# EAGLE board MSP-EXP430FR4133 (EAGLE 6.5.0)
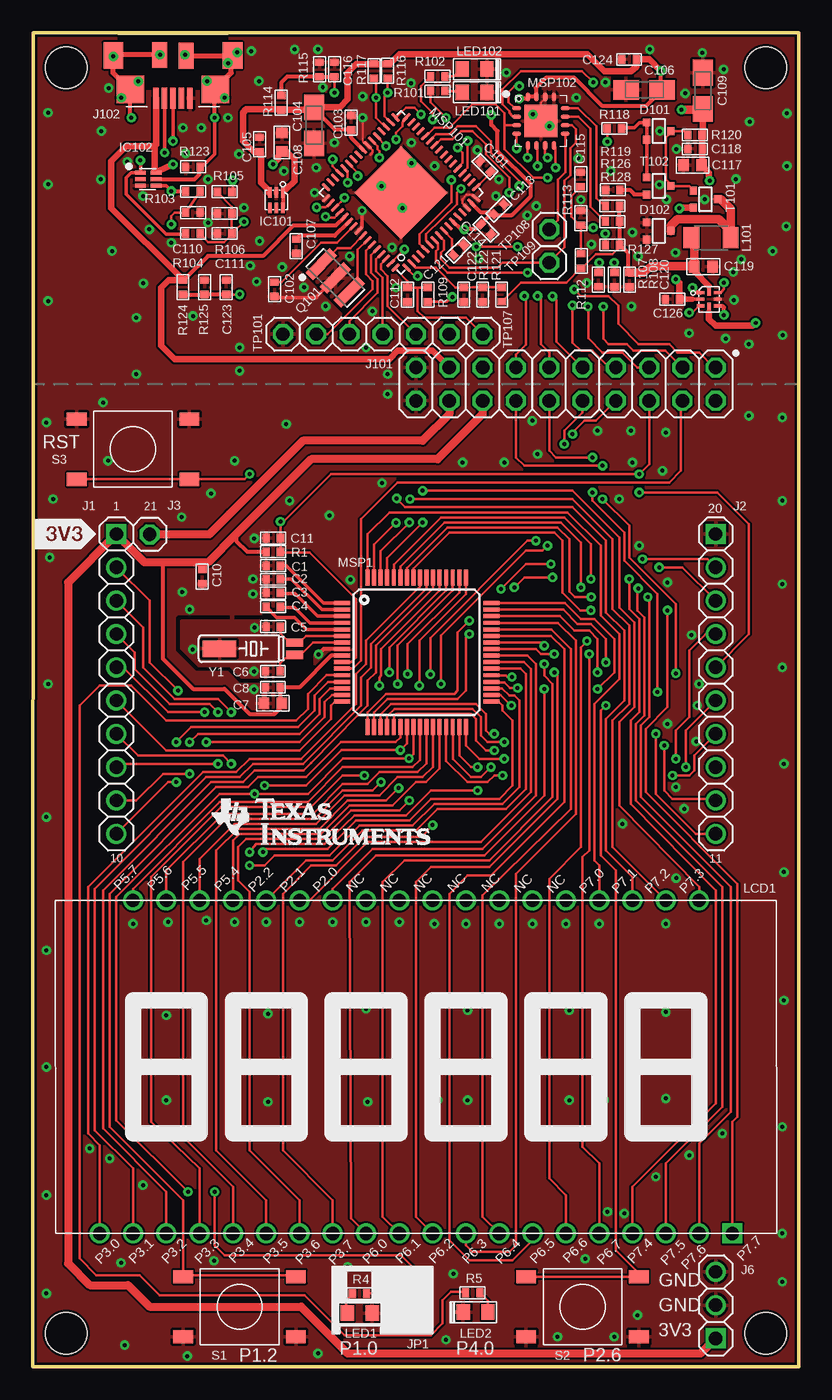
[diagram p6: board, top side]
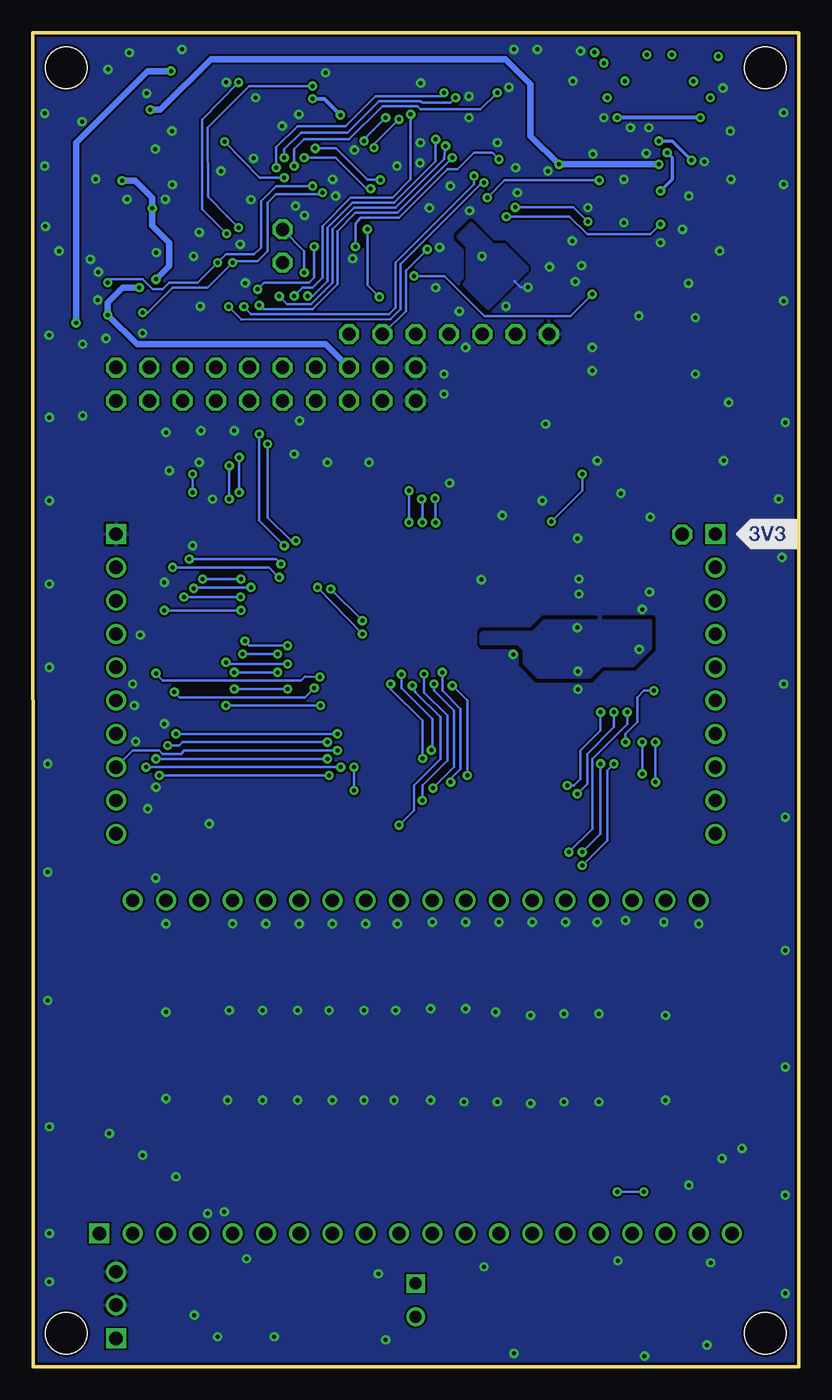
[diagram p7: board, bottom side, seen from below]

Size 58.45 x 101.73 mm. Coordinates in mm from the lower left corner, seen from the top.
Outline: 0,0 58.42,0 58.45,101.73 0.03,101.73 0,0
Copper layers (1*16): Top 0.0178mm / dielectric 12mil / Bottom 0.0178mm
Design rules "default": minimum track width 6mil, minimum drill 12mil, track to track 6mil, track to pad 6mil, pad to pad 6mil, via to via 8mil, smd to smd 0mil, copper to edge 8mil, drill to drill 8mil, minimum pad ring 10mil, minimum via ring 8mil, stop-mask expansion 3mil, vias tented up to drill 15mil, thermal gap 8mil
tRestrict: area 20.5,80.4 to 26.3,87.5; area 10.9,52.2 to 24.5,57.3
bRestrict: area 20.5,80.4 to 26.3,87.5; area 10.9,52.2 to 24.5,57.3

## Footprints (pad centres in the part's own frame; a part is rotated, then mirrored left to right if it is on the bottom)
C0402 = smd 0.55 x 0.65: 1 -0.55,0; 2 0.55,0
C0603 = smd 0.8 x 0.9: 1 -0.7,-0.05; 2 0.7,-0.05
A/3216-18R = smd 1.95 x 1.5: + 1.375,0; - -1.375,0
SOT323 = smd 0.6 x 0.55: 1 -0.65,-0.825; 2 0.65,-0.825; 3 0,1.025
WSON_DSE = smd 0.25 x 0.8: 1 0,0; 2 0.5,0; 3 1,0; 5 0.5,1.15; 6 0,1.15; P4 1,1.15
SON(DRY)6 = smd 0.81 x 0.305: 1 -0.1,0; 2 -0.1,-0.5; 3 -0.1,-1; 4 1.1,-1; 5 1.1,-0.5; 6 1.1,0
UQFN_RSE = smd 0.25 x 0.58: 1 -0.5,-0.65; 2 0,-0.65; 3 0.5,-0.65; 5 0.5,0.65; 6 0,0.65; 7 -0.5,0.65 | smd 0.58 x 0.25: 4 0.55,0; 8 -0.55,0
PINHEAFER1X10 = drill 1.016 square: 1 -11.43,0 | drill 1.016: 2 -8.89,0; 3 -6.35,0; 4 -3.81,0; 5 -1.27,0; 6 1.27,0; 7 3.81,0; 8 6.35,0; 9 8.89,0; 10 11.43,0
1X01 = drill 1.016 octagon: 1 0,0
PINHEADER1X3 = drill 1.016 square: 1 -2.54,0 | drill 1.016: 2 0,0; 3 2.54,0
2X10 = drill 1.016 octagon: 1 -11.43,-1.27; 2 -11.43,1.27; 3 -8.89,-1.27; 4 -8.89,1.27; 5 -6.35,-1.27; 6 -6.35,1.27; 7 -3.81,-1.27; 8 -3.81,1.27; 9 -1.27,-1.27; 10 -1.27,1.27; 11 1.27,-1.27; 12 1.27,1.27; 13 3.81,-1.27; 14 3.81,1.27; 15 6.35,-1.27; 16 6.35,1.27; 17 8.89,-1.27; 18 8.89,1.27; 19 11.43,-1.27; 20 11.43,1.27
EZFET_UX62M-B-5P = smd 0.42 x 1.6: 1 1.3,1.3; 2 0.65,1.3; 3 0,1.3; 4 -0.65,1.3; 5 -1.3,1.3 | smd 2.1 x 2.1: S1 -3.25,0.65; S2 3.25,0.65 | smd 1.5 x 2: S3 -4.55,-1.95; S4 4.55,-1.95 | smd 1.144 x 1.949: S5 -1.016,-1.93; S6 1.016,-1.981
JUMPER-2.54 = drill 0.914 square: 1 0,-1.27 | drill 0.914: 2 0,1.27
L3216C = smd 1.2 x 1.6: 1 -1.5,0; 2 1.5,0
FH1138P = drill 1.016 square: 1 25.4,0 | drill 1.016: 2 22.86,0; 3 20.32,0; 4 17.78,0; 5 15.24,0; 6 12.7,0; 7 10.16,0; 8 7.62,0; 9 5.08,0; 10 2.54,0; 11 0,0; 12 -2.54,0; 13 -5.08,0; 14 -7.62,0; 15 -10.16,0; 16 -12.7,0; 17 -15.24,0; 18 -17.78,0; 19 -20.32,0; 20 -22.86,0; 21 -20.32,25.4; 22 -17.78,25.4; 23 -15.24,25.4; 24 -12.7,25.4; 25 -10.16,25.4; 26 -7.62,25.4; 27 -5.08,25.4; 28 -2.54,25.4; 29 0,25.4; 30 2.54,25.4; 31 5.08,25.4; 32 7.62,25.4; 33 10.16,25.4; 34 12.7,25.4; 35 15.24,25.4; 36 17.78,25.4; 37 20.32,25.4; 38 22.86,25.4
LED0805 = smd 1 x 1.2: A 1.052,0.102; C -0.848,0.102
LQFP64 = smd 1.2 x 0.3: 1 -5.649,3.623; 2 -5.649,3.123; 3 -5.649,2.623; 4 -5.649,2.123; 5 -5.649,1.623; 6 -5.649,1.123; 7 -5.649,0.623; 8 -5.649,0.123; 9 -5.649,-0.377; 10 -5.649,-0.877; 11 -5.649,-1.377; 12 -5.649,-1.877; 13 -5.649,-2.377; 14 -5.649,-2.877; 15 -5.649,-3.377; 16 -5.649,-3.877; 33 5.751,-3.877; 34 5.751,-3.377; 35 5.751,-2.877; 36 5.751,-2.377; 37 5.751,-1.877; 38 5.751,-1.377; 39 5.751,-0.877; 40 5.751,-0.377; 41 5.751,0.123; 42 5.751,0.623; 43 5.751,1.123; 44 5.751,1.623; 45 5.751,2.123; 46 5.751,2.623; 47 5.751,3.123; 48 5.751,3.623 | smd 0.3 x 1.2: 17 -3.699,-5.827; 18 -3.199,-5.827; 19 -2.699,-5.827; 20 -2.199,-5.827; 21 -1.699,-5.827; 22 -1.199,-5.827; 23 -0.699,-5.827; 24 -0.199,-5.827; 25 0.301,-5.827; 26 0.801,-5.827; 27 1.301,-5.827; 28 1.801,-5.827; 29 2.301,-5.827; 30 2.801,-5.827; 31 3.301,-5.827; 32 3.801,-5.827; 49 3.801,5.573; 50 3.301,5.573; 51 2.801,5.573; 52 2.301,5.573; 53 1.801,5.573; 54 1.301,5.573; 55 0.801,5.573; 56 0.301,5.573; 57 -0.199,5.573; 58 -0.699,5.573; 59 -1.199,5.573; 60 -1.699,5.573; 61 -2.199,5.573; 62 -2.699,5.573; 63 -3.199,5.573; 64 -3.699,5.573
RGC64 = smd 0.825 x 0.28: 1 -4.36,3.75; 2 -4.36,3.25; 3 -4.36,2.75; 4 -4.36,2.25; 5 -4.36,1.75; 6 -4.36,1.25; 7 -4.36,0.75; 8 -4.36,0.25; 9 -4.36,-0.25; 10 -4.36,-0.75; 11 -4.36,-1.25; 12 -4.36,-1.75; 13 -4.36,-2.25; 14 -4.36,-2.75; 15 -4.36,-3.25; 16 -4.36,-3.75; 33 4.36,-3.75; 34 4.36,-3.25; 35 4.36,-2.75; 36 4.36,-2.25; 37 4.36,-1.75; 38 4.36,-1.25; 39 4.36,-0.75; 40 4.36,-0.25; 41 4.36,0.25; 42 4.36,0.75; 43 4.36,1.25; 44 4.36,1.75; 45 4.36,2.25; 46 4.36,2.75; 47 4.36,3.25; 48 4.36,3.75 | smd 0.28 x 0.825: 17 -3.75,-4.36; 18 -3.25,-4.36; 19 -2.75,-4.36; 20 -2.25,-4.36; 21 -1.75,-4.36; 22 -1.25,-4.36; 23 -0.75,-4.36; 24 -0.25,-4.36; 25 0.25,-4.36; 26 0.75,-4.36; 27 1.25,-4.36; 28 1.75,-4.36; 29 2.25,-4.36; 30 2.75,-4.36; 31 3.25,-4.36; 32 3.75,-4.36; 49 3.75,4.36; 50 3.25,4.36; 51 2.75,4.36; 52 2.25,4.36; 53 1.75,4.36; 54 1.25,4.36; 55 0.75,4.36; 56 0.25,4.36; 57 -0.25,4.36; 58 -0.75,4.36; 59 -1.25,4.36; 60 -1.75,4.36; 61 -2.25,4.36; 62 -2.75,4.36; 63 -3.25,4.36; 64 -3.75,4.36 | smd 5 x 5: TP 0,0
RSA16 = smd 0.7 x 0.35: 1 -1.85,0.975; 2 -1.85,0.325; 3 -1.85,-0.325; 4 -1.85,-0.975; 9 1.85,-0.975; 10 1.85,-0.325; 11 1.85,0.325; 12 1.85,0.975 | smd 0.35 x 0.7: 5 -0.975,-1.85; 6 -0.325,-1.85; 7 0.325,-1.85; 8 0.975,-1.85; 13 0.975,1.85; 14 0.325,1.85; 15 -0.325,1.85; 16 -0.975,1.85 | smd 2.5 x 2.5: TP 0,0
CSTCR4M = smd 0.8 x 2.6: 1 -1.5,0; 2 0,0; 3 1.5,0
R0402 = smd 0.55 x 0.65: 1 -0.55,0; 2 0.55,0
T062S = smd 1.5 x 1: 1 -4.3,2.3; 2 4.3,2.3; 3 -4.3,-2.3; 4 4.3,-2.3
MOUNTHOLE_125MIL = hole 3.175: 0,0
MS3V-T1R = smd 0.635 x 1.27: P1 -0.47,-4.43; P2 0.47,-4.43 | smd 1.27 x 2.54: P3 0,1.3

## Placement (x,y rotation side)
C1  100n  [C0402]  18.34,61.09 180 top
C2  100n  [C0402]  18.34,60.05 180 top
C3  100n  [C0402]  18.34,59 180 top
C4  1u  [C0402]  18.34,57.96 180 top
C5  12p  [C0402]  18.34,56.44 180 top
C6  12p  [C0402]  18.31,53.04 180 top
C7  10u  [C0603]  18.31,50.55 180 top
C8  100n  [C0402]  18.31,51.82 180 top
C10  100n  [C0402]  12.93,60.25 270 top
C11  1n  [C0402]  18.34,63.2 180 top
C101  470n  [C0402]  34.51,91.53 135 top
C102  220n  [C0402]  18.44,82.17 270 top
C103  100n  [C0402]  24.28,94.87 90 top
C104  10u  [A/3216-18R]  21.46,94.67 90 top
C105  100n  [C0402]  17.3,93.22 90 top
C106  4.7u  [A/3216-18R]  46.63,97.38 0 top
C107  220n  [C0402]  20.09,85.45 270 top
C108  1u  [C0603]  18.95,93.37 90 top
C109  4.7u  [A/3216-18R]  51.11,97.31 270 top
C110  10p  [C0402]  12.22,88.01 0 top
C111  10p  [C0402]  14.63,86.42 180 top
C112  1n  [C0402]  28.58,81.76 270 top
C113  100n  [C0402]  35.55,88.27 45 top
C114  100n  [C0402]  34.57,86.74 315 top
C115  32p  [C0402]  41.81,90.55 270 top
C116  32p  [C0402]  23.01,98.93 270 top
C117  4.7u  [C0603]  50.33,91.57 180 top
C118  100n  [C0402]  50.51,92.88 180 top
C119  4.7u  [C0603]  51.16,83.93 0 top
C120  100n  [C0402]  45.52,82.9 270 top
C121  100n  [C0402]  32.48,85.16 45 top
C122  32p  [C0402]  32.88,81.76 90 top
C123  32p  [C0402]  14.76,82.32 270 top
C124  100n  [C0402]  45.49,99.7 180 top
C126  100n  [C0402]  48.79,81.41 180 top
D101  BAS40-05  [SOT323]  47.65,94.23 270 top
D102  BAS40-05  [SOT323]  47.65,86.61 270 top
DRAW1  [LOGO-ROCKET-10X7MM-BRD]  3.86,81.8 65 top
DRAW3  [LOGO-ROCKET-10X7MM-BRD]  34.15,38.62 7 top
IC101  [WSON_DSE]  19.08,89.53 180 top
IC102  TPD4E004DRYR  [SON(DRY)6]  8.31,91.06 0 top
IC103  TS5A21366RSER  [UQFN_RSE]  51.59,81.41 270 top
J1  [PINHEAFER1X10]  6.38,52.07 270 top
J2  [PINHEAFER1X10]  52.1,52.07 270 top
J3  TEST_PIN2  [1X01]  8.92,63.47 0 top
J6  [PINHEADER1X3]  52.1,4.7 90 top
J101  [2X10]  40.67,74.93 180 top
J102  Micro-USB  [EZFET_UX62M-B-5P]  10.69,98.04 180 top
JP1  [JUMPER-2.54]  29.24,5.08 180 top
L101  2u2  [L3216C]  51.73,86.1 180 top
LCD1  [FH1138P]  27.97,10.16 0 top
LED1  Red  [LED0805]  25.04,4.19 180 top
LED2  Green  [LED0805]  33.68,4.06 0 top
LED101  Red  [LED0805]  33.81,97.28 180 top
LED102  Green  [LED0805]  33.81,99.06 180 top
MSP1  MSP430FR4x  [LQFP64]  29.24,54.61 0 top
MSP101  MSP430F5528IRGC  [RGC64]  28.09,89.54 135 top
MSP102  MSP430G2452IRSA16R  [RSA16]  38.76,95 0 top
Q101  PIEZO_CSTCR4M00G15L99  [CSTCR4M]  23.08,83.02 315 top
R1  47k  [R0402]  18.34,62.15 0 top
R4  470  [R0402]  24.92,5.59 180 top
R5  470  [R0402]  33.55,5.64 0 top
R101  470  [R0402]  30.89,97.28 180 top
R102  470  [R0402]  30.89,98.41 180 top
R103  27  [R0402]  12.22,89.63 0 top
R104  27  [R0402]  12.22,86.42 0 top
R105  1k4  [R0402]  14.63,89.6 0 top
R106  1M  [R0402]  14.63,87.95 180 top
R107  47k  [R0402]  43.15,82.91 270 top
R108  47k  [R0402]  44.37,82.91 270 top
R109  47k  [R0402]  30.14,81.76 270 top
R112  220k  [R0402]  41.84,84.33 90 top
R113  220k  [R0402]  41.81,87.6 90 top
R114  220k  [R0402]  18.95,96.39 90 top
R115  220k  [R0402]  21.87,98.93 90 top
R116  4k7  [R0402]  27.06,98.82 270 top
R117  4k7  [R0402]  26.03,98.82 270 top
R118  820  [R0402]  44.37,94.42 180 top
R119  0  [R0402]  44.24,89.75 180 top
R120  470  [R0402]  50.51,93.94 180 top
R121  220k  [R0402]  35.78,81.76 90 top
R122  220k  [R0402]  34.32,81.76 270 top
R123  33k  [R0402]  12.22,91.5 180 top
R124  240k  [R0402]  11.46,82.32 270 top
R125  150k  [R0402]  13.11,82.32 90 top
R126  2k2  [R0402]  44.22,88.52 180 top
R127  3k3  [R0402]  44.22,85.55 180 top
R128  6k8  [R0402]  44.22,87.33 180 top
S1  T062S  [T062S]  15.77,4.57 180 top
S2  T062S  [T062S]  41.94,4.57 180 top
S3  T062S  [T062S]  7.65,69.98 0 top
T101  DMG1013UW  [SOT323]  51.21,89.03 270 top
T102  BC850CW-115  [SOT323]  47.65,90.04 270 top
TP101  TEST_PIN2  [1X01]  19.08,78.74 0 top
TP102  TEST_PIN2  [1X01]  21.62,78.74 0 top
TP103  TEST_PIN2  [1X01]  24.16,78.74 0 top
TP104  TEST_PIN2  [1X01]  26.7,78.74 0 top
TP105  TEST_PIN2  [1X01]  29.24,78.74 0 top
TP106  TEST_PIN2  [1X01]  31.78,78.74 0 top
TP107  TEST_PIN2  [1X01]  34.32,78.74 0 top
TP108  TEST_PIN2  [1X01]  39.4,86.74 0 top
TP109  TEST_PIN2  [1X01]  39.4,84.2 0 top
U$2  MOUNTHOLE_125MIL  [MOUNTHOLE_125MIL]  2.57,2.54 0 top
U$3  MOUNTHOLE_125MIL  [MOUNTHOLE_125MIL]  2.57,99.06 0 top
U$4  [LOGO16_TPLACE]  13.55,39.64 0 top
U$5  MOUNTHOLE_125MIL  [MOUNTHOLE_125MIL]  55.91,2.54 0 top
U$6  MOUNTHOLE_125MIL  [MOUNTHOLE_125MIL]  55.91,99.06 0 top
U$7  SILK_3V3_TAG  [SILK_3V3_TAG]  0.03,62.36 0 top
U$8  SILK_FR4133_REAR_REV02  [SILK_FR4133_REAR_REV02]  0.03,0.13 0 top
Y1  32.768kHz  [MS3V-T1R]  15.54,54.76 90 top

## Tracks (layer width: path | path; a pad name or v marks a point on that pad's centre or on a via)
5V
  Top 0.152: 8.92,63.5 J3.1
  Top 0.61: J101.18 31.78,72.64 29.74,70.61 20.6,70.61 15.01,65.02 13.46,63.48 J3.1
+3V3
  Top 0.203: 19.01,50.36 C7.1
  Top 0.305: MSP1.9 22.76,54.23 20.35,51.82 C8.1 18.86,50.47 C7.1 19.01,50.57 | 15.52,63.5 15.52,62.98 16.35,62.15 R1.1 | 10.06,61.34 9.93,61.21 9.93,53.98 12.22,51.69 14.63,51.69 16.54,49.78 18.44,49.78 19.01,50.36 | C10.1 12.93,61.34
  Top 0.61: J6.1 50.95,1.02 24.03,1.02 20.47,4.57 8.92,4.57 7.26,6.22 4.34,6.22 2.69,7.87 2.69,59.82 J1.1 8.53,61.34 10.06,61.34 12.93,61.34 13.36,61.34 15.52,63.5 21.23,69.22 30.89,69.22 34.32,72.64 J101.16
EZFET_AVBUS  (via drill 0.3)
  Top 0.203: v29.36,83.19 29.11,83.19 28.52,83.77 MSP101.1 | C123.2 15.38,81.77 v15.77,81.79
  Top 0.305: R124.2 12.96,81.77 12.98,81.79 13.12,81.79 | C123.2 R125.1 13.12,81.79 | 13.23,81.79 13.12,81.79
  Bottom 0.203: v29.36,83.19 27.03,83.19 23.98,80.14 17.42,80.14 v15.77,81.79
EZFET_AVCC  (via drill 0.3)
  Top 0.152: 38.51,93.08 38.51,93.09 MSP102.6
  Top 0.203: 23.01,98.28 v23.01,97.16 | v38.51,91.57 38.51,93.08
  Top 0.305: 23.01,98.28 C116.2 | C116.2 23.01,98.43 22.97,98.38 R115.1 19.41,98.38 18.95,97.92 R114.2 | 23.01,98.3 C116.2 | C116.2 | R114.2
  Bottom 0.203: v23.01,97.16 24.28,95.89 28.85,95.89 29.11,96.14 31.78,96.14 34.32,93.6 37.74,93.6 38.51,92.84 v38.51,91.57
EZFET_AVCCOUT  (via drill 0.3)
  Top 0.152: 36.73,96.01 36.86,96.01 MSP102.1
  Top 0.203: R113.1 41.81,85.98 41.81,84.96 41.83,84.96 R112.2 | R113.1 42.03,86.87 v42.75,86.87 | 36.73,96.01 36.27,96.44 36.27,97.21 36.73,97.66 v37.11,97.66 | 41.78,89.97 41.78,89.94 41.83,89.89 41.86,89.92 | 41.86,89.82 41.86,89.92 | 41.86,89.92 41.86,89.95 41.83,89.97 | C115.2 41.79,90 41.07,89.28 41.07,87.71 41.68,87.1 41.77,86.84 R113.1
  Top 0.508: C115.2 41.78,89.97
  Bottom 0.203: v37.11,97.66 41.94,97.66 45.11,94.49 45.09,89.23 43.61,87.76 v42.75,86.87
EZFET_AVCCOUT2ADC
  Top 0.203: R121.2 34.21,82.31 R122.1 33.59,82.31 C122.2 32.55,82.31 32.25,82.31 30.76,83.82 29.21,83.82 MSP101.2
EZFET_DCDCCAL0
  Top 0.203: R126.2 43.7,88.39 43.33,88.77 42.98,89.13 42.98,94.62 41.6,95.97 MSP102.12
EZFET_DCDCCAL1  (via drill 0.3)
  Top 0.203: MSP102.2 36.85,95.38 36.6,95.38 36.35,95.63 36.35,95.76 35.84,96.27 35.84,97.41 37.24,98.81 41.88,98.81 v42.75,97.94 | R127.2 43.67,85.51 43.66,85.88 43.66,86.34 43.69,86.36 43.66,86.36 v43.66,86.41
  Bottom 0.203: v42.75,97.94 45.54,95.1 45.54,88.27 v43.66,86.41
EZFET_DCDCCAL2
  Top 0.203: R128.2 42.55,88.45 42.55,94.41 41.63,95.33 40.63,95.33 MSP102.11
EZFET_DCDCIO0  (via drill 0.3)
  Top 0.203: v36.91,92.91 36.91,93.15 MSP102.4 | v31.93,90.5 31.93,88.8 29.49,86.36 29.49,85.66 MSP101.5
  Bottom 0.203: v36.91,92.91 35.31,92.91 32.92,90.53 32.16,90.53 v31.93,90.5
EZFET_DCDCIO1  (via drill 0.3)
  Top 0.203: 30.12,85.74 MSP101.6 30,85.86 30,86.36 32.35,88.66 32.36,88.67 32.36,89.53 v32.66,89.84 | v37.74,92.2 37.74,93.11 MSP102.5
  Bottom 0.203: v37.74,92.2 35.33,92.2 32.97,89.84 v32.66,89.84
EZFET_DCDCPULSE  (via drill 0.3)
  Top 0.203: R118.2 43.82,93.72 v43.82,93.42 | v39.27,90.68 38.18,90.68 35.97,92.84 35.97,94.74 | 35.97,94.74 35.97,95.61 35.31,96.27 33.55,96.27 31.78,94.49 30.63,94.49 30,93.86 MSP101.28 | 35.97,94.74 36.04,94.67 MSP102.3
  Bottom 0.203: v39.27,90.68 41.15,90.68 v43.82,93.42
EZFET_DCDCRST  (via drill 0.3)
  Top 0.203: MSP101.7 30.66,85.9 30.91,85.65 30.91,85.24 30.76,85.09 30.76,84.33 31.65,83.44 v37.74,83.44 | 40.78,93.98 MSP102.9 40.61,91.08 40.06,90.53 40.06,87.43 TP108.1 | TP108.1 39.42,86.77 39.37,86.82 TP108.1
  Top 0.305: TP108.1
  Bottom 0.203: TP108.1 | TP108.1 37.74,85.09 v37.74,83.44
EZFET_DCDCTEST
  Top 0.203: MSP101.8 31,86.25 31.37,85.88 31.37,85.19 31.14,84.96 31.14,84.46 31.78,83.82 35.46,83.82 35.84,84.2 TP109.1 39.8,84.61 40.56,85.37 40.56,90.45 41,90.88 41,92.91 41.43,93.34 41.43,94.36 41.12,94.67 40.74,94.67 40.67,94.74 40.67,94.62 MSP102.10
EZFET_DM  (via drill 0.3)
  Top 0.203: J102.2 10.04,96.66
  Top 0.254: IC102.4 10.17,90.06 v10.57,89.66 | 10.04,96.66 v10.06,92.58
  Top 0.305: v10.57,89.66 11.58,89.66 11.61,89.63 R103.1
  Bottom 0.254: v10.57,89.66 9.68,90.55 9.68,92.2 v10.06,92.58
EZFET_DP  (via drill 0.3)
  Top 0.254: v8.2,92 v8.21,92.01 IC102.1 7.52,91.06 7.14,90.68 7.14,89.41 10.19,86.36 11.5,86.36 R104.1 | J102.3 v10.69,93.47
  Bottom 0.254: v10.69,93.47 9.68,93.47 v8.2,92
EZFET_HOSTSCL  (via drill 0.3)
  Top 0.152: MSP101.35 26.95,94.62 26.95,94.61
  Top 0.203: 26.95,94.61 26.83,94.61 26.19,95.25 v26.19,96.77 26.19,98.25 | v39.27,92.2 39.09,92.36 MSP102.7
  Top 0.305: 26.19,98.25 R117.2
  Bottom 0.203: v26.19,96.77 26.57,96.39 28.73,96.39 28.85,96.52 32.03,96.52 34.44,94.11 38,94.11 39.27,92.84 v39.27,92.2
EZFET_HOSTSDA  (via drill 0.3)
  Top 0.203: MSP101.34 27.28,94.92 26.82,95.38 26.82,96.9 v27.08,97.16 27.08,98.16 R116.2 | MSP102.8 39.88,92.98 v39.88,91.44
  Bottom 0.203: v27.08,97.16 27.33,96.9 32.28,96.9 34.57,94.62 38.25,94.62 39.88,92.99 v39.88,91.44
EZFET_LED0  (via drill 0.3)
  Top 0.203: MSP101.20 33.17,91.44 v33.17,93.47 | v31.52,95.25 30.34,96.44 R101.2
  Bottom 0.203: v33.17,93.47 33.17,93.6 v31.52,95.25
EZFET_LED1  (via drill 0.3)
  Top 0.203: R102.2 30.24,98.28 29.62,97.66 29.62,96.52 30.51,95.63 v30.51,95.12 | MSP101.21 32.41,91.44 32.79,91.82 32.79,92.58 v32.41,92.96
  Bottom 0.203: v32.41,92.96 32.41,93.22 v30.51,95.12
EZFET_NC_TMSC  (via drill 0.3)
  Top 0.203: J101.1 51.97,76.2 50.83,77.34 49.17,77.34 48.54,77.98 46.2,77.98 44.65,79.53 44.65,80.92 43.92,81.66 41.81,81.66 v41.3,82.17 | MSP101.45 22.89,91.57 v22.89,92.08 | 36.98,85.47 v36.98,85.42 36.98,85.34 36.93,85.42 v33.83,85.42
  Bottom 0.203: v22.89,92.08 23.39,92.58 24.79,92.58 26.06,91.31 26.82,91.31 30.51,87.63 33.43,87.63 33.83,87.17 v33.83,85.42 | v36.98,85.42 36.98,83.06 37.36,82.68 40.79,82.68 v41.3,82.17
EZFET_PU.0/DP  (via drill 0.3)
  Top 0.152: 22.76,88.77 MSP101.50
  Top 0.203: v16.1,87.33 15.33,86.55 C111.1 | R105.1 15.18,88.48 R106.1 15.18,87.47 C111.1 | R104.2 13.39,85.78 14.58,85.78 15.15,86.35 C111.1 | 22.76,88.77 22.5,88.52 22.45,88.52 22.35,88.42 v21.64,88.42
  Bottom 0.203: v16.1,87.33 17.2,88.42 v21.64,88.42
EZFET_PU.1/DM  (via drill 0.3)
  Top 0.203: R103.2 12.74,89.56 C110.1 10.82,88.01 10.57,87.76 v10.57,87.12 | MSP101.52 23.01,87.63 22.5,87.63 v22.33,87.71
  Bottom 0.203: v22.33,87.71 17.5,87.71 16.15,86.36 11.33,86.36 v10.57,87.12
EZFET_PUR  (via drill 0.3)
  Top 0.203: MSP101.51 23.52,88.85 v23.77,89.15 | v15.24,90.48 15.25,89.7 R105.2
  Bottom 0.203: v15.24,90.48 22.45,90.48 v23.77,89.15
EZFET_RST
  Top 0.203: MSP101.64 27.79,83.62 28.6,82.8 28.6,82.37 C112.1 R109.1 | TP107.1 33.05,80.01 29.87,80.01 29.36,80.52 29.36,82.3 30.12,82.3 R109.1 | R109.1 | R109.1 30.12,82.3
EZFET_SBWTCK  (via drill 0.3)
  Top 0.203: MSP101.44 23.75,91.39 24.03,91.11 v24.03,90.3 | J101.3 48.26,77.47 45.82,77.47 45.31,77.98 43.92,77.98 43.51,78.38 v43.51,80.85
  Bottom 0.203: v24.03,90.3 24.28,90.17 30.38,84.07 30.38,80.65 31.14,79.88 42.52,79.86 v43.51,80.85
EZFET_SBWTDIO  (via drill 0.3)
  Top 0.203: MSP101.43 24.79,91.06 v24.79,90.81 | J101.5 46.13,76.2 44.98,77.34 43.46,77.34 42.37,78.44 42.37,80.82 v42.34,80.85
  Bottom 0.203: v24.79,90.81 24.79,90.17 30.76,84.2 30.76,80.77 31.27,80.26 41.78,80.29 v42.34,80.85
EZFET_SHIELD  (via drill 0.3)
  Top 0.152: 14,97.03 13.87,96.9 13.87,96.77
  Top 0.203: 7.44,95.12 7.52,95.12 v7.52,95.25 | 7.44,96.77 7.39,96.77 | 7.39,96.77 7.39,97.28 | v6.76,96.77 7.39,96.77 | v14.63,96.77 13.87,96.77
  Top 0.254: R123.1 12.92,91.5 13.87,92.46 v13.87,95.25
  Top 0.305: IC102.5 12.21,90.56 12.34,90.55 12.73,90.93 12.73,91.34 R123.1 12.73,91.23 | 7.44,95.12 7.44,96.77 | v13.87,95.25 13.87,96.77
  Top 0.381: J102.S2 7.41,97.39 6.12,98.68 6.12,99.95 6.14,99.97 J102.S4 | J102.S4 v6.14,99.93 v6.15,99.92 | 14,97.03 14,97.45 | J102.S2 7.44,97.33 7.39,97.28 | v8.05,98.02 8.05,98 J102.S2 | v13.28,98.04 v13.29,98.04 J102.S1 14,97.45 | 14,97.45 14,97.54 15.14,98.68 15.14,99.16 v14.88,99.42 14.88,99.64 J102.S3 | v15.6,100.23 15.6,99.97 J102.S3 | J102.S3 15.22,99.97 J102.S5 11.68,99.97 v11.61,100.05 | 9.68,100.05 6.2,100.05 J102.S4
  Top 0.406: J102.S6 9.68,100.05 v9.7,100.05
  Bottom 0.305: v7.52,95.25 v13.87,95.25
EZFET_TCK  (via drill 0.3)
  Top 0.203: v28.35,85.22 27.31,84.18 MSP101.63
  Bottom 0.203: v28.35,85.22 29.97,83.59 29.97,80.49 TP106.1 | TP106.1
EZFET_TDI
  Top 0.203: MSP101.61 26.59,84.86 26.19,84.46 26.19,83.57 26.7,83.06 TP104.1 | TP104.1
EZFET_TDO
  Top 0.203: TP103.1 24.16,79.76 26.31,81.92 26.31,82.93 25.81,83.44 25.81,84.77 MSP101.60
EZFET_TEST
  Top 0.203: 25.93,85.6 25.92,85.6 MSP101.59 25.43,85.1 25.43,83.31 25.93,82.8 25.93,82.17 22.5,78.74 TP102.1
EZFET_TMS
  Top 0.203: MSP101.62 26.95,84.46 26.57,84.07 26.57,83.69 27.08,83.19 27.08,80.9 TP105.1
EZFET_UARTCTS  (via drill 0.3)
  Top 0.203: 28.35,95.12 28.22,94.87 28.22,94.62 27.71,94.11 v27.71,93.6 | 37.62,81.53 v37.49,81.66 37.62,81.53 | J101.13 36.86,77.19 37.62,77.95 37.62,81.53
  Top 0.254: MSP101.32 28.49,95.27 28.35,95.12
  Bottom 0.203: v27.71,93.6 27.71,91.95 30.89,88.77 34.06,88.77 35.97,86.87 35.97,82.8 37.11,81.66 v37.49,81.66
EZFET_UARTRTS  (via drill 0.3)
  Top 0.203: 27.69,95.27 27.71,95.25 | 27.84,95.12 27.71,95.25 | 27.71,95.25 28.47,96.01 29.11,96.01 v29.62,95.5 | J101.11 39.4,77.34 38.76,77.98 38.76,81.41 v38.51,81.66
  Top 0.254: MSP101.33 27.69,95.27
  Bottom 0.203: v29.62,95.5 29.62,90.55 31.01,89.15 34.19,89.15 36.35,87 36.35,83.06 37.11,82.3 37.87,82.3 v38.51,81.66